# EasyEDA Pro project 第十五届蓝桥杯EDA赛项模拟试题二（嘉立创EDA提供）.eprj, board PCB-PockerMultimater1 (continued)
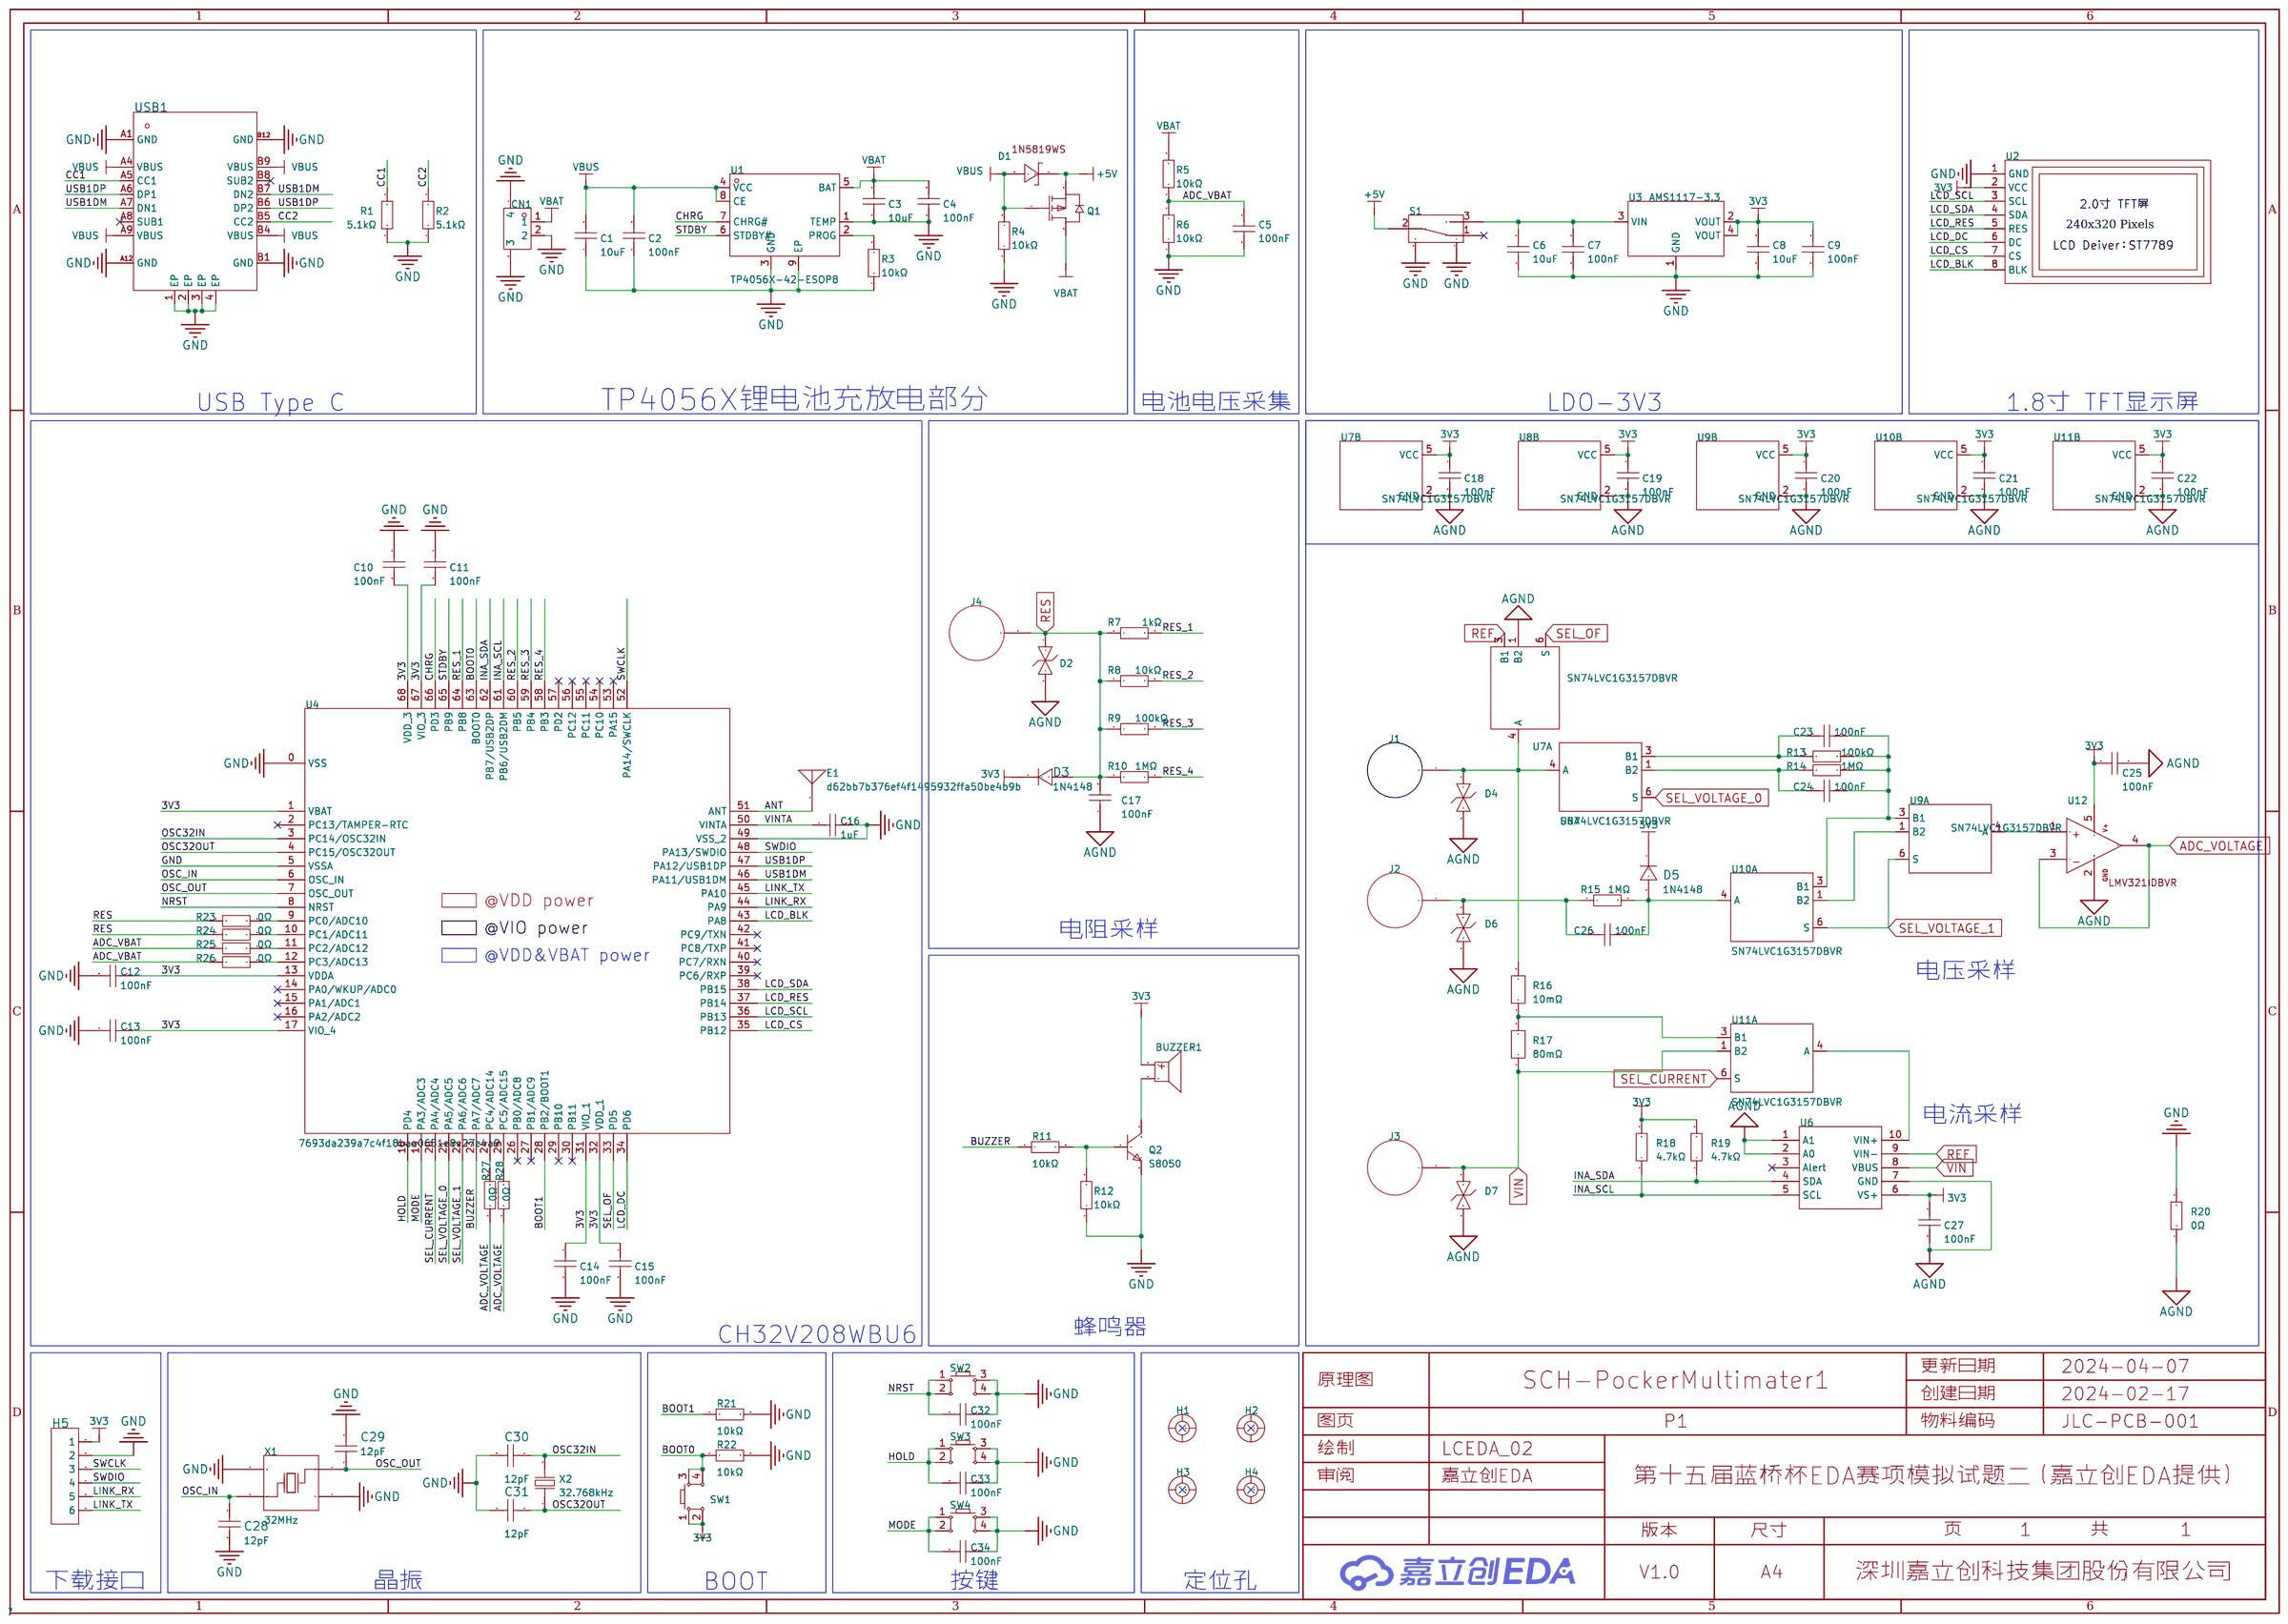
[diagram p0: schematic sheet]
## Copper pours and planes (outline as drawn; the poured copper is in the pictures) (continued)
VBUS on Top Layer: 16.81,32.21 16.61,32.41 16.61,33.6 16.66,33.66 19.3,33.66 19.43,33.53 19.43,32.33 19.3,32.21
VBUS on Bottom Layer: 11.28,28.98 12.95,28.98 16.61,32.64 16.61,33.6 16.87,33.6 16.92,33.66 18.72,33.66 19.08,33.3 19.08,32.56 18.85,32.33 17.6,32.33 12.91,27.65 11.81,27.65 11.81,26.24 11.49,25.92 10.58,25.92 10.49,26.01 10.49,28.19
$1N25880 on Top Layer: 5.36,48.56 1.65,48.56 1.45,48.77 1.45,50.09 1.52,50.17 5.89,50.17 6.25,49.81 9.42,49.81 9.73,49.5 9.73,48.62 9.25,48.13 9.25,45.42 9.07,45.24 8.99,45.31 8,45.31 8,48.37 7.8,48.57 5.36,48.57

Small or netless copper shapes (teardrops, artwork), in the pictures only: 559 on Top Layer, 67 on Bottom Layer

## Text on the board
Top Silkscreen Layer: 3V3 | GND | SWCLK | SWDIO | RX | TX
